# EasyEDA Pro project YanQi_Project_V2.0.eprj, board PayloadBoard
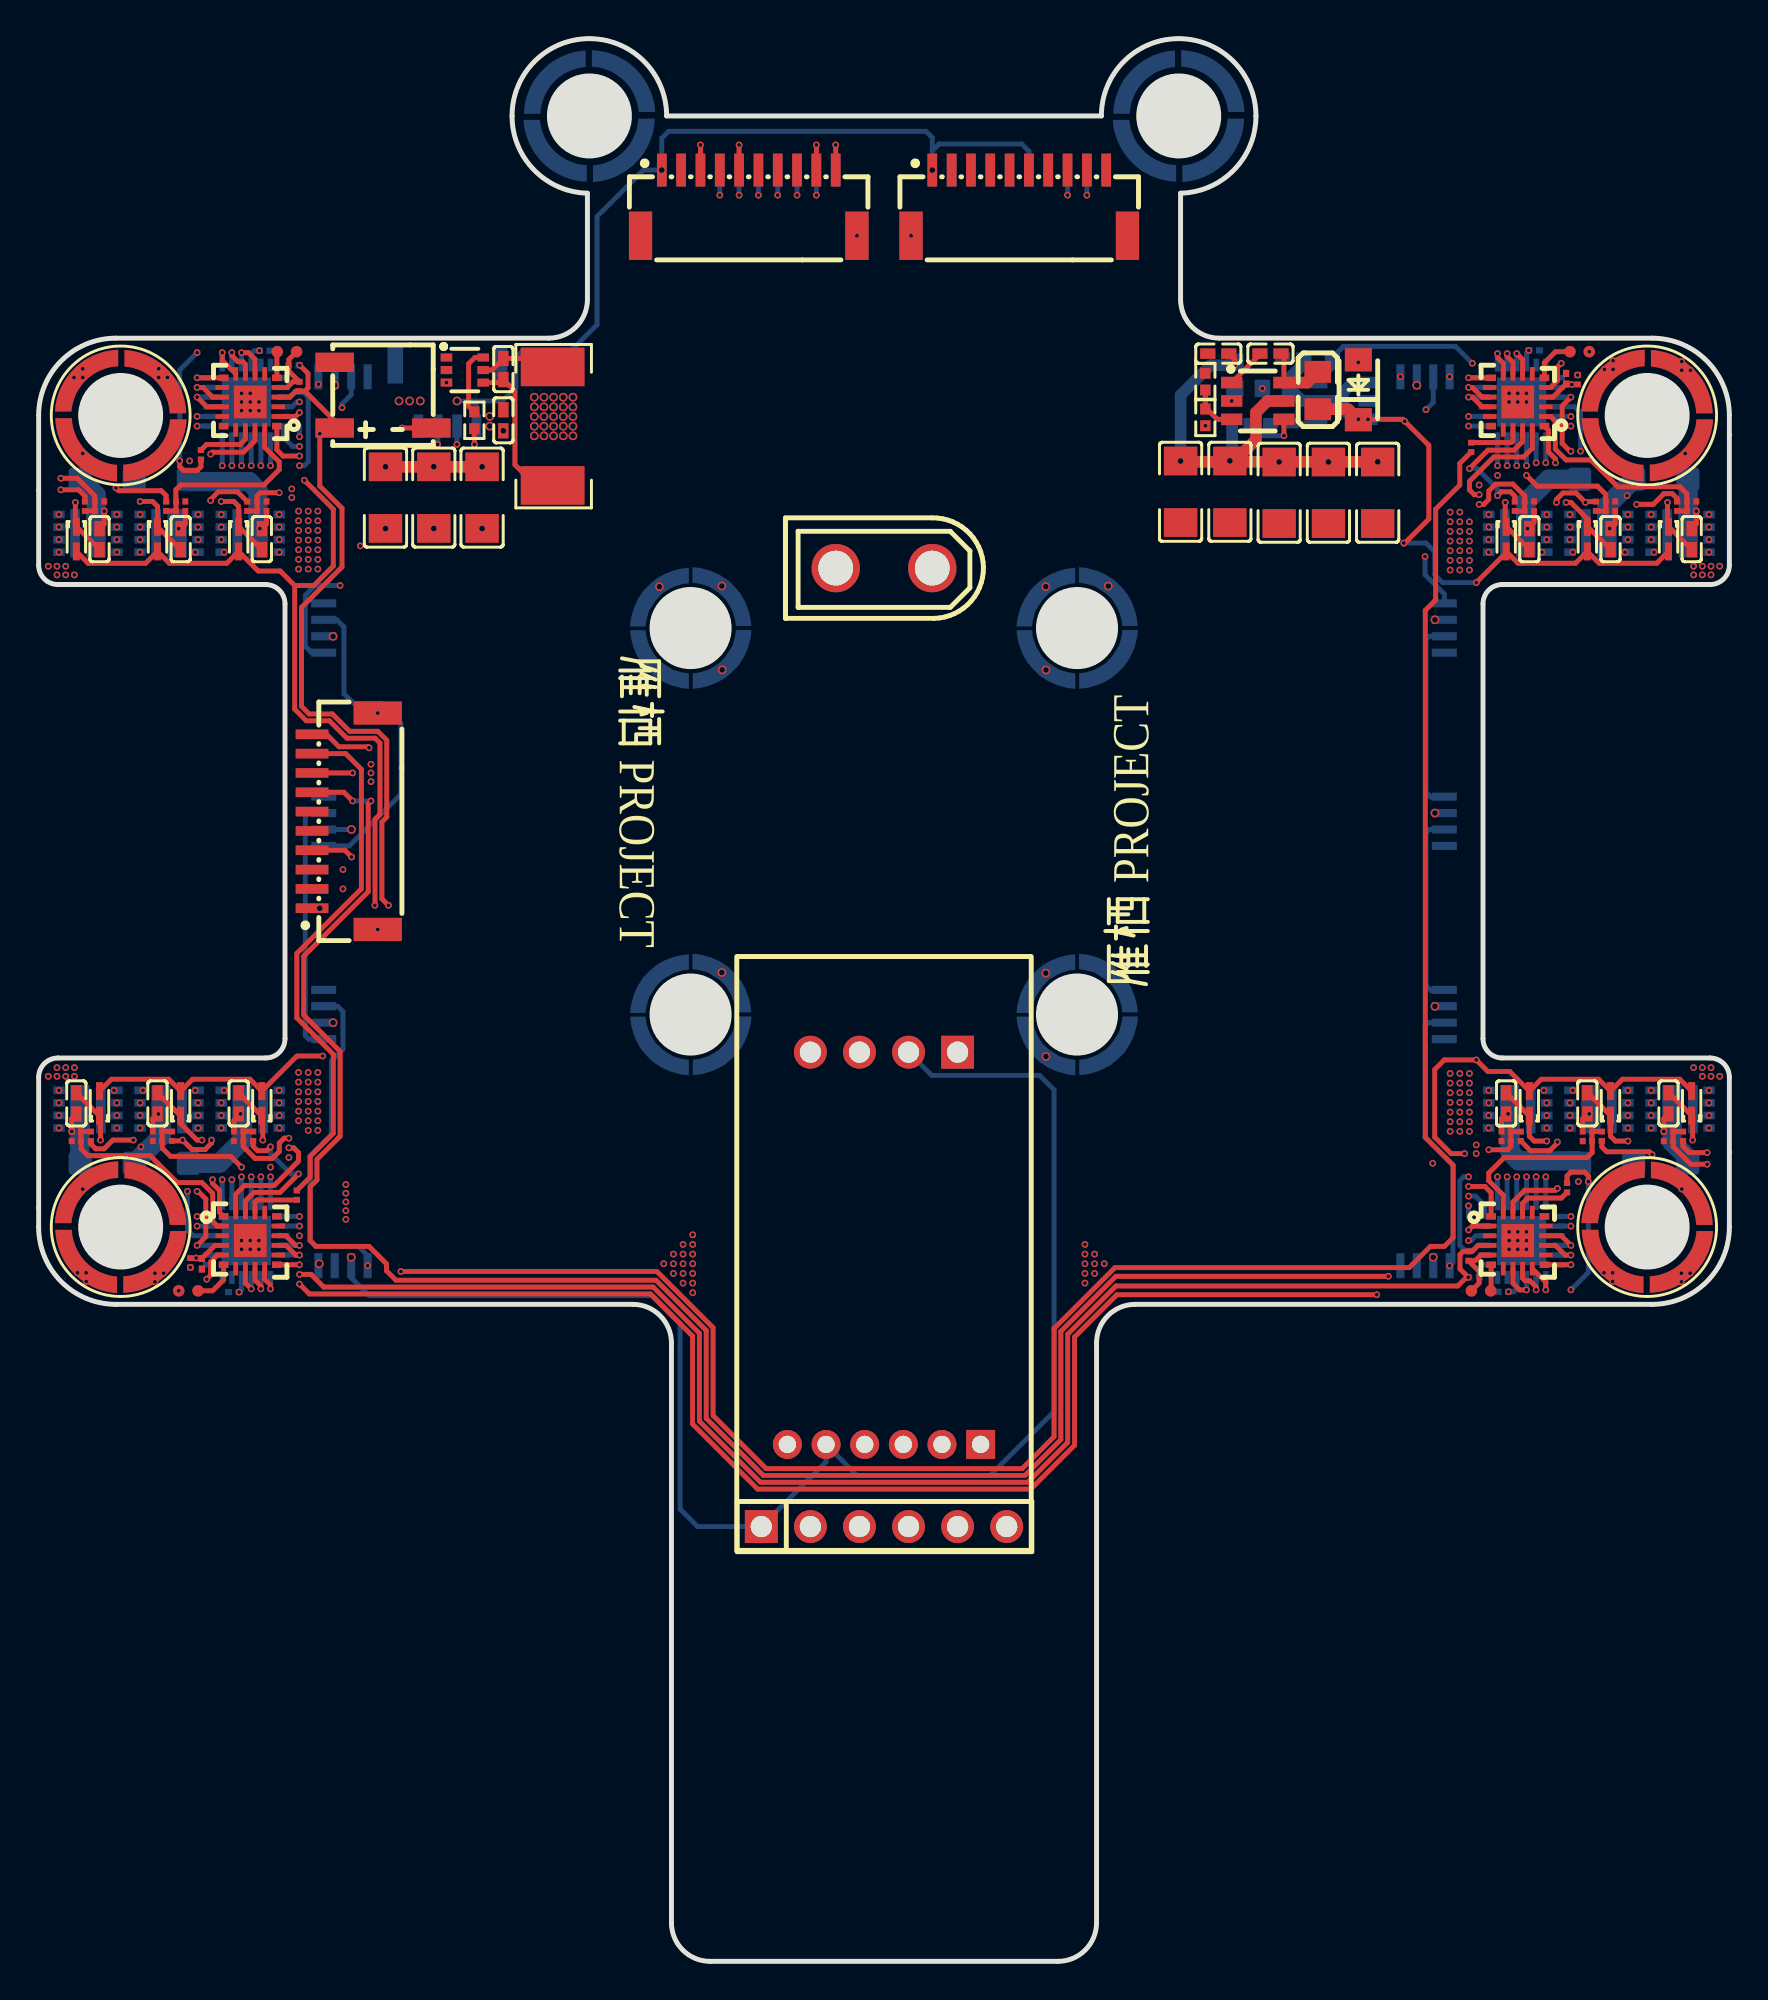
[diagram p6: board, top side]
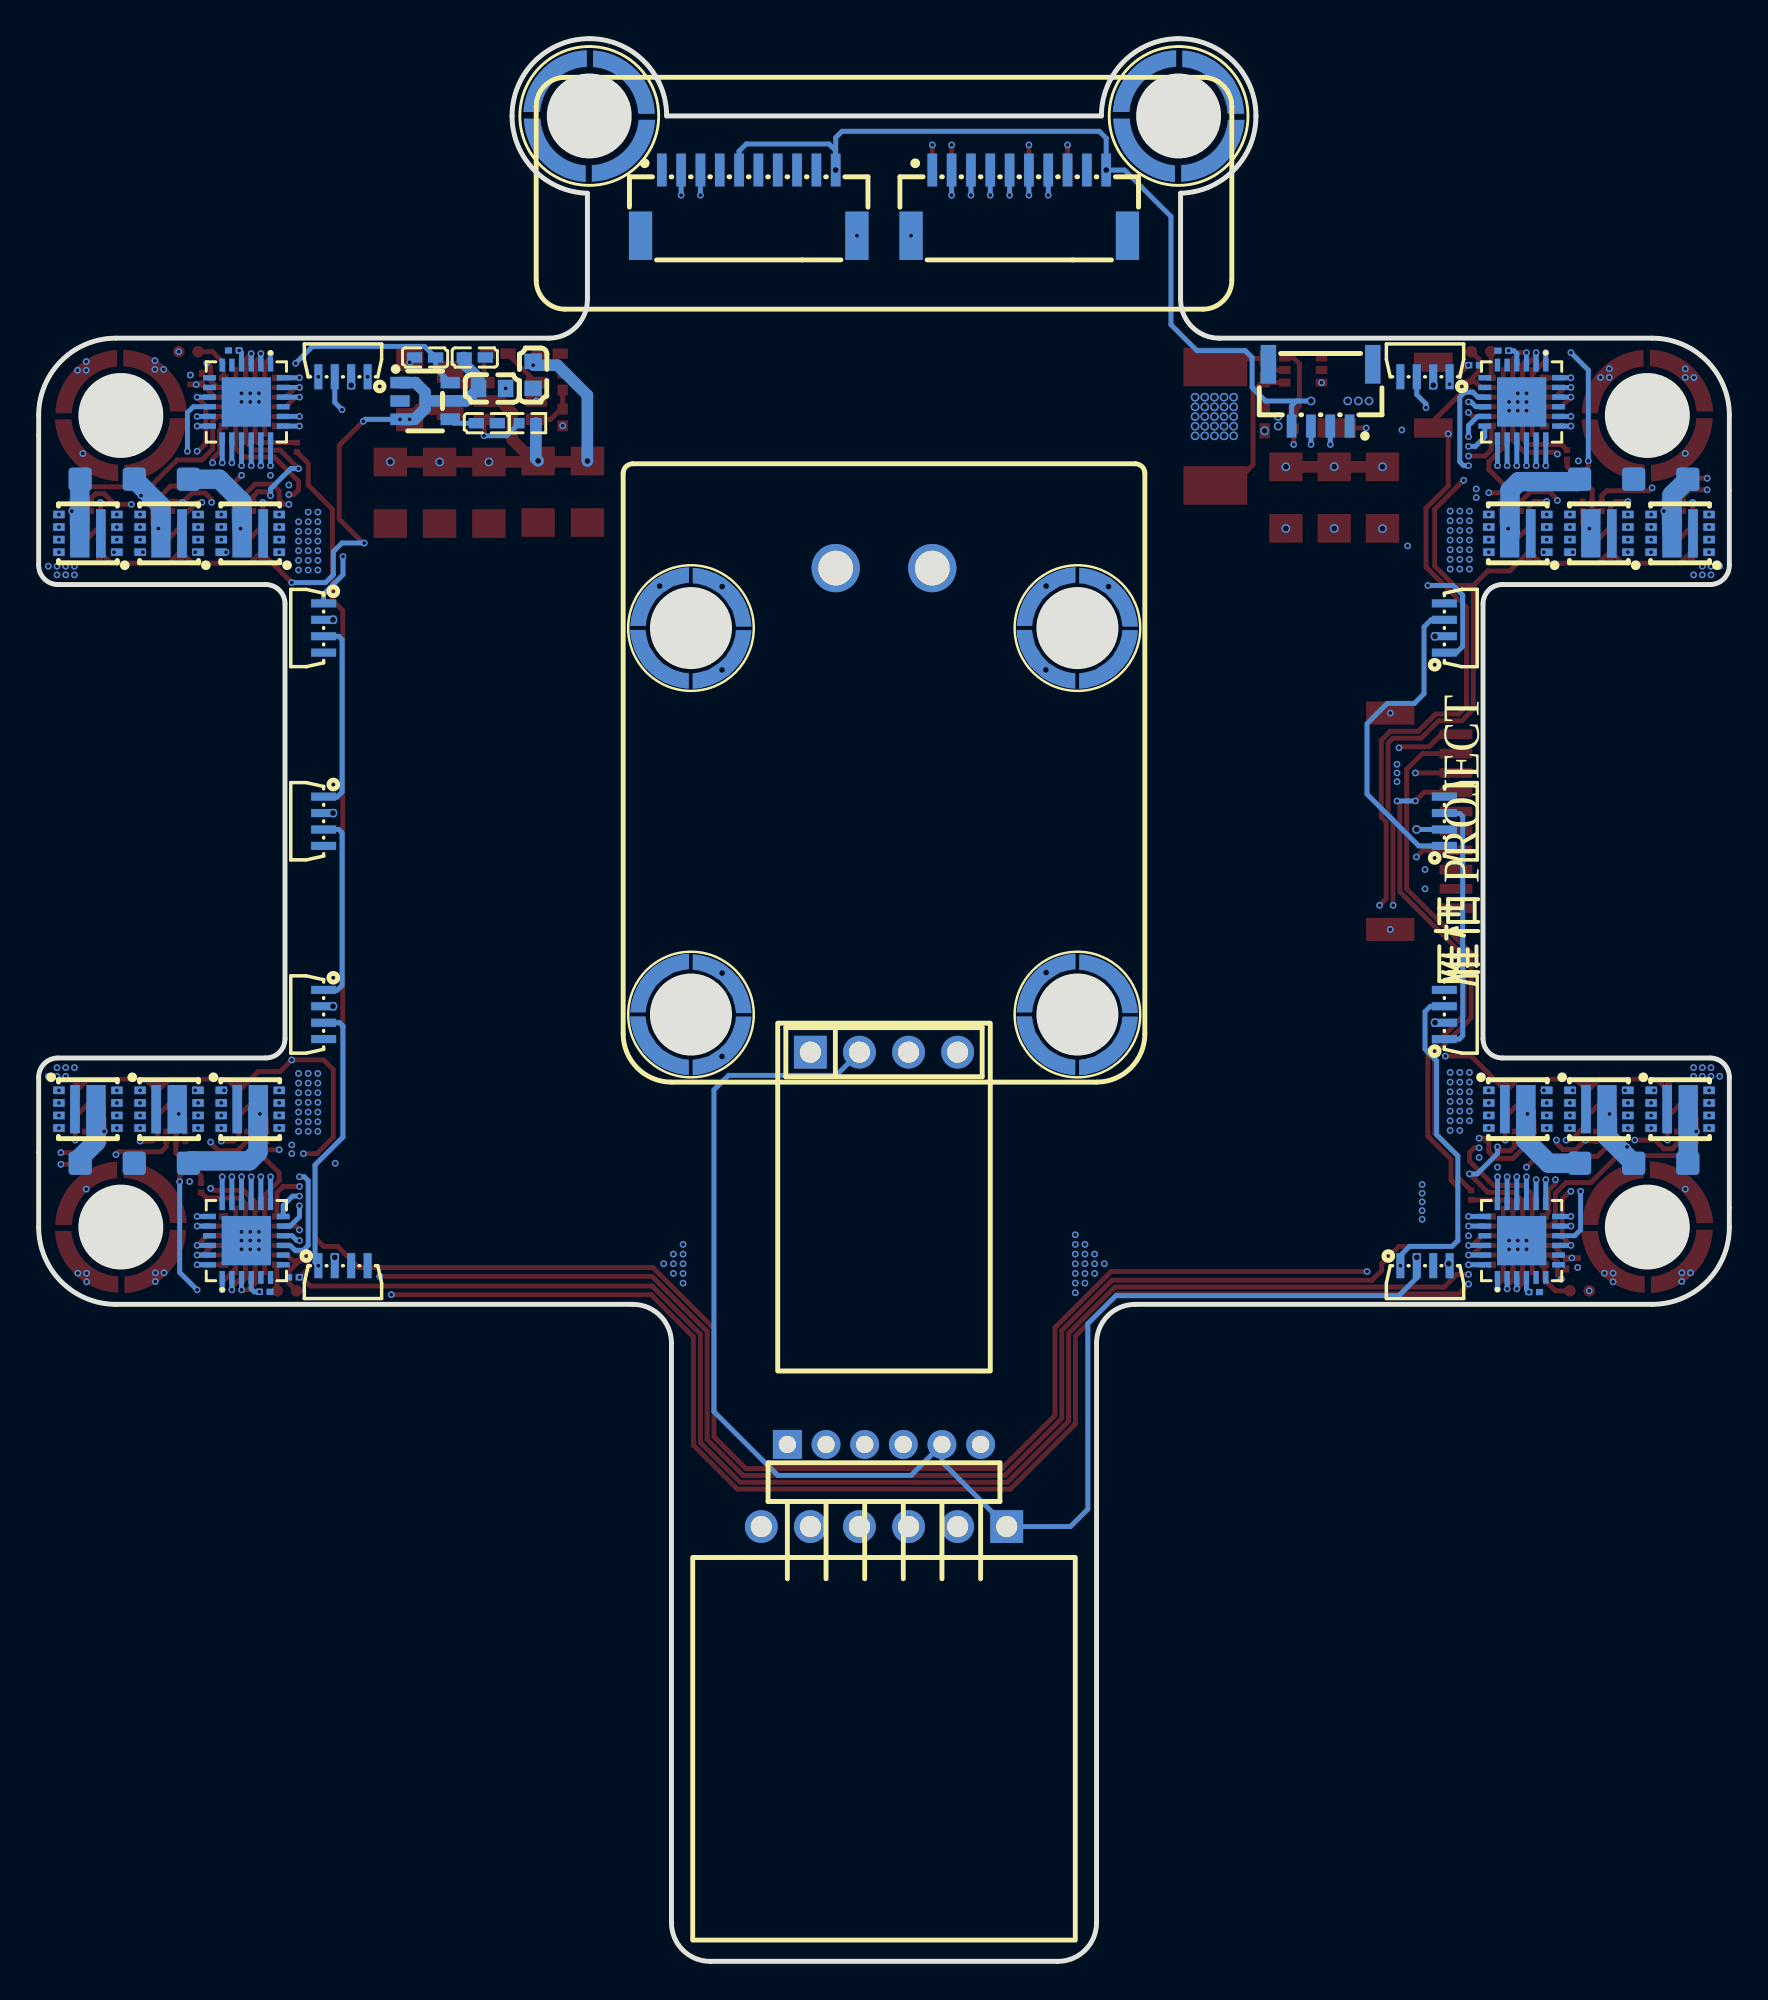
[diagram p7: board, bottom side, seen from below]

Outline 87.5 x 99.5 mm; copper layers: Top Layer, Inner1, Inner2, Bottom Layer. Coordinates in mm from the lower left corner of the outline.
Outline path: 0,80 0,72.25 arc(0.29,71.54) 1,71.25 11.75,71.25 arc(12.46,70.96) 12.75,70.25 12.75,47.75 arc(12.46,47.04) 11.75,46.75 1,46.75 arc(0.29,46.46) 0,45.75 0,38 arc(1.17,35.17) 4,34 30.75,34 arc(32.16,33.41) 32.75,32 32.75,2 arc(33.34,0.59) 34.75,0 52.75,0 arc(54.16,0.59) 54.75,2 54.75,32 arc(55.34,33.41) 56.75,34 83.5,34 arc(86.33,35.17) 87.5,38 87.5,45.75 arc(87.21,46.46) 86.5,46.75 75.75,46.75 arc(75.04,47.04) 74.75,47.75 74.75,70.25 arc(75.04,70.96) 75.75,71.25 86.5,71.25 arc(87.21,71.54) 87.5,72.25 87.5,80 arc(86.33,82.83) 83.5,84 61.1,84 arc(59.69,84.59) 59.1,86 59.1,91.5 arc(61.86,92.71) 63,95.5 arc(61.83,98.33) 59,99.5 arc(56.17,98.33) 55,95.5 32.5,95.5 arc(31.33,98.33) 28.5,99.5 arc(25.67,98.33) 24.5,95.5 arc(25.64,92.71) 28.4,91.5 28.4,86 arc(27.81,84.59) 26.4,84 4,84 arc(1.17,82.83) 0,80
Stack: Top Layer 0.035mm / Dielectric1 0.48mm PP er 4.5 / Inner1 0.035mm / Dielectric2 0.48mm FR4 er 4.5 / Inner2 0.035mm / Dielectric3 0.48mm PP er 4.5 / Bottom Layer 0.035mm

## Design rules (mm)
template: 自定义配置
spacing copperThickness1oz (default): track to track 0.1, other pairs 0.15 to 0.3
spacing copperThickness2oz: track to track 0.203, other pairs 0.152 to 0.3
spacing copperThicknessInner0.5oz: track to track 0.089, other pairs 0.152 to 0.3
track width copperThickness1oz (default): min 0.102, default 0.254, max 10
track width copperThickness2oz: min 0.203, default 0.254, max 10
track width copperThickness0.5oz: min 0.089, default 0.254, max 10
differential pair differentialPair (default): width min 0.127, default 0.254, max 2.54; gap min 0.152, default 0.152
via viaSize (default): diameter min 0.3, default 0.45, max 10; hole min 0.2, default 0.3, max 6.3

## Placement (name value [footprint] x y rotation side)
BUZZER1  4000Hz  [BUZ-SMD_4P-L5.0-W5.0-P4.00-BR]  17.82 81.05 270 top
C1  1uF  [C0402]  85.55 73.6 270 top
C2  1uF  [C0402]  81.35 73.6 270 top
C3  100nF  [C0201]  79.05 81.9 90 top
C4  100nF  [C0201]  77.4 83.36 180 bottom
C5  1uF  [C0402]  77.15 73.6 270 top
C6  1uF  [C0402]  1.95 44.4 90 top
C7  1uF  [C0402]  6.15 44.4 90 top
C8  100nF  [C0201]  8.45 36.1 270 top
C9  100nF  [C0201]  10.1 34.64 0 bottom
C10  1uF  [C0402]  10.35 44.4 90 top
C11  1uF  [C0402]  3.15 73.6 270 top
C12  1uF  [C0402]  7.35 73.6 270 top
C13  100nF  [C0201]  13.21 82.6 180 bottom
C14  100nF  [C0201]  11.7 83.35 180 bottom
C15  1uF  [C0402]  11.55 73.6 270 top
C16  1uF  [C0402]  84.35 44.4 90 top
C17  1uF  [C0402]  80.15 44.4 90 top
C18  100nF  [C0201]  74.29 35.4 0 bottom
C19  100nF  [C0201]  75.8 34.65 0 bottom
C20  1uF  [C0402]  75.95 44.4 90 top
C21  100nF  [C0402_NEW]  63.75 83.2 180 top
C22  100nF  [C0402_NEW]  61.05 83.2 0 top
C23  4.7uF  [C0603]  61.91 82.1 90 bottom
C24  10uF  [C0603]  64.03 81.4 0 bottom
C25  10uF  [C1206]  59.1 76.05 90 top
C26  10uF  [C1206]  61.65 76.05 90 top
C27  10uF  [C1206]  64.2 76 90 top
C28  10uF  [C1206]  66.75 76 90 top
C29  10uF  [C1206]  69.3 76 90 top
C30  10uF  [C1206]  17.95 75.75 90 top
C31  10uF  [C1206]  20.45 75.75 90 top
C32  10uF  [C1206]  22.95 75.75 90 top
C33  2.2uF  [C0402]  67.5 83 0 bottom
C34  1uF  [C0402]  64.93 83 0 bottom
C35  100nF  [C0402_NEW]  24.05 79.75 270 top
C36  1nF  [C0402]  24.05 82.4 90 top
C37  100nF  [C0402_NEW]  64.31 79.6 0 bottom
CN1  HDGC1002WV-S-4P  [CONN-SMD_4P-P1.00_HDGC_HDGC1002WV-S-4P]  21.15 81.05 0 bottom
CN2  XT30UPB-M  [CONN-TH_XT30UPB-M]  43.75 72.1 180 top
D1  1N4148WT T4  [SOD-523_L1.2-W0.8-LS1.6-RD]  84.35 73.6 270 top
D2  1N4148WT T4  [SOD-523_L1.2-W0.8-LS1.6-RD]  80.15 73.6 270 top
D3  1N4148WT T4  [SOD-523_L1.2-W0.8-LS1.6-RD]  75.95 73.6 270 top
D4  1N4148WT T4  [SOD-523_L1.2-W0.8-LS1.6-RD]  3.15 44.4 90 top
D5  1N4148WT T4  [SOD-523_L1.2-W0.8-LS1.6-RD]  7.35 44.4 90 top
D6  1N4148WT T4  [SOD-523_L1.2-W0.8-LS1.6-RD]  11.55 44.4 90 top
D7  1N4148WT T4  [SOD-523_L1.2-W0.8-LS1.6-RD]  1.95 73.6 270 top
D8  1N4148WT T4  [SOD-523_L1.2-W0.8-LS1.6-RD]  6.15 73.6 270 top
D9  1N4148WT T4  [SOD-523_L1.2-W0.8-LS1.6-RD]  10.35 73.6 270 top
D10  1N4148WT T4  [SOD-523_L1.2-W0.8-LS1.6-RD]  85.55 44.4 90 top
D11  1N4148WT T4  [SOD-523_L1.2-W0.8-LS1.6-RD]  81.35 44.4 90 top
D12  1N4148WT T4  [SOD-523_L1.2-W0.8-LS1.6-RD]  77.15 44.4 90 top
D13  -  [端口]  85.35 76.7 180 bottom
D14  -  [端口]  82.55 76.7 0 bottom
D15  -  [端口]  79.75 76.7 180 bottom
D16  -  [端口]  2.15 76.7 0 bottom
D17  -  [端口]  4.95 76.7 180 bottom
D18  -  [端口]  7.75 76.7 180 bottom
D19  -  [端口]  2.15 41.3 0 bottom
D20  -  [端口]  4.95 41.3 0 bottom
D21  -  [端口]  7.75 41.3 180 bottom
D22  -  [端口]  85.35 41.3 180 bottom
D23  -  [端口]  82.55 41.3 180 bottom
D24  -  [端口]  79.75 41.3 180 bottom
H1  PZ254V-11-04P  [HDR-TH_4P-P2.54-V-M]  43.75 47.05 180 bottom
H2  PZ200-1-06-W  [HDR-TH_6P-P2.00-H-M-W7.2-N]  43.75 26.75 180 bottom
H3  PZ254V-11-06P  [HDR-TH_6P-P2.54-V-M]  43.75 22.5 0 top
L1  6.8uH  [L0805]  66.2 81.29 270 top
LED1  WS2812B-4020  [LED-SMD_WS2812B-4020]  71.75 82 180 bottom
LED2  WS2812B-4020  [LED-SMD_WS2812B-4020]  72.75 69 90 bottom
LED3  WS2812B-4020  [LED-SMD_WS2812B-4020]  72.75 59 90 bottom
LED4  WS2812B-4020  [LED-SMD_WS2812B-4020]  72.75 49 90 bottom
LED5  WS2812B-4020  [LED-SMD_WS2812B-4020]  71.75 36 0 bottom
LED6  WS2812B-4020  [LED-SMD_WS2812B-4020]  15.75 82 180 bottom
LED7  WS2812B-4020  [LED-SMD_WS2812B-4020]  14.75 69 270 bottom
LED8  WS2812B-4020  [LED-SMD_WS2812B-4020]  14.75 59 270 bottom
LED9  WS2812B-4020  [LED-SMD_WS2812B-4020]  14.75 49 270 bottom
LED10  WS2812B-4020  [LED-SMD_WS2812B-4020]  15.75 36 0 bottom
Q1  AON7934  [DFN-8_L3.0-W3.0-P0.65-BL_AON7934]  84.95 73.9 90 bottom
Q2  AON7934  [DFN-8_L3.0-W3.0-P0.65-BL_AON7934]  80.75 73.9 90 bottom
Q3  AON7934  [DFN-8_L3.0-W3.0-P0.65-BL_AON7934]  76.55 73.9 90 bottom
Q4  AON7934  [DFN-8_L3.0-W3.0-P0.65-BL_AON7934]  2.55 73.9 90 bottom
Q5  AON7934  [DFN-8_L3.0-W3.0-P0.65-BL_AON7934]  6.75 73.9 90 bottom
Q6  AON7934  [DFN-8_L3.0-W3.0-P0.65-BL_AON7934]  10.95 73.9 90 bottom
Q7  AON7934  [DFN-8_L3.0-W3.0-P0.65-BL_AON7934]  2.55 44.1 270 bottom
Q8  AON7934  [DFN-8_L3.0-W3.0-P0.65-BL_AON7934]  6.75 44.1 270 bottom
Q9  AON7934  [DFN-8_L3.0-W3.0-P0.65-BL_AON7934]  10.95 44.1 270 bottom
Q10  AON7934  [DFN-8_L3.0-W3.0-P0.65-BL_AON7934]  84.95 44.1 270 bottom
Q11  AON7934  [DFN-8_L3.0-W3.0-P0.65-BL_AON7934]  80.75 44.1 270 bottom
Q12  AON7934  [DFN-8_L3.0-W3.0-P0.65-BL_AON7934]  76.55 44.1 270 bottom
R1  10kΩ  [R0201]  74.14 78.35 270 top
R2  47kΩ  [R0201]  85.55 75.05 0 top
R3  47kΩ  [R0201]  81.35 75.05 0 top
R4  47kΩ  [R0201]  77.15 75.05 0 top
R5  10kΩ  [R0201]  84.8 75.3 270 top
R6  10kΩ  [R0201]  80.6 75.3 270 top
R7  1kΩ  [R0201]  79.65 81.85 90 top
R8  10kΩ  [R0201]  76.4 75.3 270 top
R9  4.7kΩ  [R0201]  85.55 75.55 180 top
R10  4.7kΩ  [R0201]  81.35 75.55 180 top
R11  4.7kΩ  [R0201]  77.15 75.55 180 top
R12  10kΩ  [R0201]  13.36 39.65 90 top
R13  47kΩ  [R0201]  1.95 42.95 180 top
R14  47kΩ  [R0201]  6.15 42.95 180 top
R15  47kΩ  [R0201]  10.35 42.95 180 top
R16  10kΩ  [R0201]  2.7 42.7 90 top
R17  10kΩ  [R0201]  6.9 42.7 90 top
R18  1kΩ  [R0201]  7.85 36.15 270 top
R19  10kΩ  [R0201]  11.1 42.7 90 top
R20  4.7kΩ  [R0201]  1.95 42.45 0 top
R21  4.7kΩ  [R0201]  6.15 42.45 0 top
R22  4.7kΩ  [R0201]  10.35 42.45 0 top
R23  10kΩ  [R0201]  8.4 77.97 270 top
R24  47kΩ  [R0201]  3.15 75.05 0 top
R25  47kΩ  [R0201]  7.35 75.05 0 top
R26  47kΩ  [R0201]  11.55 75.05 0 top
R27  10kΩ  [R0201]  2.4 75.3 270 top
R28  10kΩ  [R0201]  6.6 75.3 270 top
R29  1kΩ  [R0201]  13.5 81.5 90 top
R30  10kΩ  [R0201]  10.8 75.3 270 top
R31  4.7kΩ  [R0201]  3.15 75.55 180 top
R32  4.7kΩ  [R0201]  7.35 75.55 180 top
R33  4.7kΩ  [R0201]  11.55 75.55 180 top
R34  10kΩ  [R0201]  79.1 40.04 90 top
R35  47kΩ  [R0201]  84.35 42.95 180 top
R36  47kΩ  [R0201]  80.15 42.95 180 top
R37  47kΩ  [R0201]  75.95 42.95 180 top
R38  10kΩ  [R0201]  85.1 42.7 90 top
R39  10kΩ  [R0201]  80.9 42.7 90 top
R40  1kΩ  [R0201]  74 36.5 270 top
R41  10kΩ  [R0201]  76.7 42.7 90 top
R42  4.7kΩ  [R0201]  84.35 42.45 0 top
R43  4.7kΩ  [R0201]  80.15 42.45 0 top
R44  4.7kΩ  [R0201]  75.95 42.45 0 top
R45  100kΩ  [R0402]  62.2 79.6 180 bottom
R46  10K  [R0402]  60.38 81.75 270 top
R47  90.9kΩ  [R0402]  60.38 79.9 270 top
R48  56Ω  [R0402]  22.55 79.75 270 top
R49  10mΩ  [RES-SMD_L6.4-W3.2-R2512]  26.6 79.44 270 top
U1  EFM8BB21F16G-C-QFN20R  [QFN-20_L3.0-W3.0-P0.50-BL-EP1.7_EFM8BB21F16G]  76.55 80.7 90 top
U2  FD6288Q  [QFN-24_L4.0-W4.0-P0.50-BL-EP2.6]  76.75 80.7 0 bottom
U3  EFM8BB21F16G-C-QFN20R  [QFN-20_L3.0-W3.0-P0.50-BL-EP1.7_EFM8BB21F16G]  10.95 37.3 270 top
U4  FD6288Q  [QFN-24_L4.0-W4.0-P0.50-BL-EP2.6]  10.75 37.3 180 bottom
U5  EFM8BB21F16G-C-QFN20R  [QFN-20_L3.0-W3.0-P0.50-BL-EP1.7_EFM8BB21F16G]  10.95 80.7 90 top
U6  FD6288Q  [QFN-24_L4.0-W4.0-P0.50-BL-EP2.6]  10.75 80.7 0 bottom
U7  EFM8BB21F16G-C-QFN20R  [QFN-20_L3.0-W3.0-P0.50-BL-EP1.7_EFM8BB21F16G]  76.55 37.3 270 top
U8  FD6288Q  [QFN-24_L4.0-W4.0-P0.50-BL-EP2.6]  76.75 37.3 180 bottom
U9  JW5026  [SOT-23-6_L2.9-W1.6-P0.95-LS2.8-BR]  63.09 80.75 180 top
U10  -  [烧录点]  80.25 83.3 0 top
U11  -  [烧录点]  7.25 34.7 180 top
U12  -  [烧录点]  13.35 83.3 0 top
U13  -  [烧录点]  74.15 34.7 0 top
U14  SMF8.0A  [SOD-123FL_L2.8-W1.8-LS3.6-RD]  68.3 81.33 90 top
U15  -  [烧录点]  79.25 83.3 0 top
U16  -  [烧录点]  8.25 34.7 180 top
U17  -  [烧录点]  12.35 83.3 0 top
U18  -  [烧录点]  75.15 34.7 0 top
U19  INA199A1DCKR  [SC-70-6_L2.2-W1.3-P0.65-LS2.1-BR]  22.06 82.35 180 top
U20  AP2210K-3.3TRG1  [SOT-23-5_L3.0-W1.7-P0.95-LS2.8-BR]  67.5 80.75 0 bottom
U21  SMTSO3050CTJ  [SMD_SMTSO3060CTJ]  4.25 80 0 top
U22  SMTSO3050CTJ  [SMD_SMTSO3060CTJ]  83.25 80 0 top
U23  SMTSO3050CTJ  [SMD_SMTSO3060CTJ]  4.25 38 0 top
U24  SMTSO3050CTJ  [SMD_SMTSO3060CTJ]  83.25 38 0 top
U25  WAFER-SH1.0-10PWB  [CONN-SMD_10P-P1.00_WAFER-SH1.0-10PWB]  36.75 91 0 top
U26  WAFER-SH1.0-10PWB  [CONN-SMD_10P-P1.00_WAFER-SH1.0-10PWB]  50.75 91 0 top
U27  WAFER-SH1.0-10PWB  [CONN-SMD_10P-P1.00_WAFER-SH1.0-10PWB]  15.85 59 90 top
U28  SMTSO3015CTJ  [SMD_BD5.6-L5.6-W5.6-D4.1]  53.75 49 180 bottom
U29  SMTSO3015CTJ  [SMD_BD5.6-L5.6-W5.6-D4.1]  33.75 49 180 bottom
U30  SMTSO3015CTJ  [SMD_BD5.6-L5.6-W5.6-D4.1]  53.75 69 180 bottom
U31  SMTSO3015CTJ  [SMD_BD5.6-L5.6-W5.6-D4.1]  33.75 69 180 bottom
U32  SMTSO3050CTJ  [SMD_SMTSO3060CTJ]  28.5 95.5 180 bottom
U33  SMTSO3050CTJ  [SMD_SMTSO3060CTJ]  59 95.5 180 bottom
U34  WAFER-SH1.0-10PWB  [CONN-SMD_10P-P1.00_WAFER-SH1.0-10PWB]  36.75 91 180 bottom
U35  WAFER-SH1.0-10PWB  [CONN-SMD_10P-P1.00_WAFER-SH1.0-10PWB]  50.75 91 180 bottom

## Footprints (pads in the part's own frame, mm; a bottom-side part is the same pattern mirrored in y, then rotated)
BUZ-SMD_4P-L5.0-W5.0-P4.00-BR
  rect 1x2 smd: 1(1.7,-2.5) 2(1.7,2.5) 3(-1.7,-2.5)
C0201
  rect 0.368x0.324 smd: 1(-0.275,0) 2(0.275,0)
C0402
  rect 0.79x0.54 smd: 1(-0.545,0) 2(0.545,0)
C0402_NEW
  rect 0.79x0.54 smd: 1(-0.545,0) 2(0.545,0)
C0603
  rect 0.8x0.9 smd: 1(-0.7,0) 2(0.7,0)
C1206
  rect 1.485x1.728 smd: 1(-1.593,0) 2(1.593,0)
CONN-SMD_4P-P1.00_HDGC_HDGC1002WV-S-4P
  rect 0.5x1.2 smd: 1(-1.5,1.6) 2(-0.5,1.6) 3(0.5,1.6) 4(1.5,1.6)
  rect 0.8x2 smd: 5(2.7,-1.6) 6(-2.7,-1.6)
CONN-SMD_10P-P1.00_WAFER-SH1.0-10PWB
  rect 0.5x1.7 smd: 1(-4.5,1.7) 2(-3.5,1.7) 3(-2.5,1.7) 4(-1.5,1.7) 5(-0.5,1.7) 6(0.5,1.7) 7(1.5,1.7) 8(2.5,1.7) 9(3.5,1.7) 10(4.5,1.7)
  rect 1.2x2.5 smd: 11(5.6,-1.7) 12(-5.6,-1.7)
CONN-TH_XT30UPB-M
  round 2.5 hole 1.8: 1(-2.5,0) 2(2.5,0)
DFN-8_L3.0-W3.0-P0.65-BL_AON7934
  rect 0.4x0.6 smd: 1(-0.975,-1.5) 2(-0.325,-1.5) 3(0.325,-1.5) 4(0.975,-1.5) 5(0.975,1.5) 6(0.325,1.5) 7(-0.325,1.5) 8(-0.975,1.5)
  rect 2.5x0.5 smd: 9(0,-0.67)
  rect 2.5x1 smd: 10(0,0.42)
HDR-TH_4P-P2.54-V-M
  rect 1.7x1.7 hole 1.1: 1(-3.81,0)
  round 1.7 hole 1.1: 2(-1.27,0) 3(1.27,0) 4(3.81,0)
HDR-TH_6P-P2.00-H-M-W7.2-N
  rect 1.5x1.5 hole 0.9: 1(-5,0)
  round 1.5 hole 0.9: 2(-3,0) 3(-1,0) 4(1,0) 5(3,0) 6(5,0)
HDR-TH_6P-P2.54-V-M
  rect 1.7x1.7 hole 1.1: 1(-6.35,0)
  round 1.7 hole 1.1: 2(-3.81,0) 3(-1.27,0) 4(1.27,0) 5(3.81,0) 6(6.35,0)
L0805
  rect 1.133x1.377 smd: 1(-0.966,0) 2(0.966,0)
LED-SMD_WS2812B-4020
  rect 0.42x1.3 smd: 1(1.275,0) 2(0.425,0) 3(-0.425,0) 4(-1.275,0)
QFN-20_L3.0-W3.0-P0.50-BL-EP1.7_EFM8BB21F16G
  rect 0.34x0.5 smd: 1(-1.252,-1.377) 6(1.248,-1.377) 11(1.248,1.377) 16(-1.252,1.377)
  rect 0.25x0.7 smd: 2(-0.751,-1.45) 3(-0.252,-1.45) 4(0.248,-1.45) 5(0.749,-1.45) 12(0.749,1.45) 13(0.248,1.45) 14(-0.252,1.45) 15(-0.751,1.45)
  rect 0.7x0.25 smd: 7(1.452,-0.75) 8(1.452,-0.25) 9(1.452,0.25) 10(1.452,0.75) 17(-1.452,0.75) 18(-1.452,0.25) 19(-1.452,-0.25) 20(-1.452,-0.75)
  rect 1.7x1.7 smd: 21(-0.002,0)
QFN-24_L4.0-W4.0-P0.50-BL-EP2.6
  rect 0.28x0.665 smd: 1(-1.25,-1.907) 2(-0.75,-1.907) 3(-0.25,-1.907) 4(0.25,-1.907) 5(0.75,-1.907) 6(1.25,-1.907) 13(1.25,1.907) 14(0.75,1.907) 15(0.25,1.907) 16(-0.25,1.907) 17(-0.75,1.907) 18(-1.25,1.907)
  rect 0.665x0.28 smd: 7(1.907,-1.25) 8(1.907,-0.75) 9(1.907,-0.25) 10(1.907,0.25) 11(1.907,0.75) 12(1.907,1.25) 19(-1.907,1.25) 20(-1.907,0.75) 21(-1.907,0.25) 22(-1.907,-0.25) 23(-1.907,-0.75) 24(-1.907,-1.25)
  rect 2.55x2.55 smd: 25(0,0)
R0201
  rect 0.303x0.324 smd: 1(-0.241,0) 2(0.241,0)
R0402
  rect 0.566x0.54 smd: 1(-0.433,0) 2(0.433,0)
RES-SMD_L6.4-W3.2-R2512
  rect 2x3.3 smd: 1(-3.067,0) 2(3.067,0)
SC-70-6_L2.2-W1.3-P0.65-LS2.1-BR
  rect 0.6x0.42 smd: 1(0.95,-0.65) 2(0.95,0) 3(0.95,0.65) 4(-0.95,0.65) 5(-0.95,0) 6(-0.95,-0.65)
SMD_BD5.6-L5.6-W5.6-D4.1
  custom 3.04x3.04 smd: 1(-1.623,-2.167) 1(-1.609,2.171) 1(1.617,-2.171) 1(1.623,2.141)
SMD_SMTSO3060CTJ
  custom 3.197x3.279 smd: 1(-1.79,-2.369)
  custom 3.279x3.197 smd: 1(-1.769,2.386) 1(1.768,-2.386)
  custom 3.197x3.278 smd: 1(1.79,2.34)
SOD-123FL_L2.8-W1.8-LS3.6-RD
  rect 1.2x1.4 smd: 1(-1.55,0) 2(1.55,0)
SOD-523_L1.2-W0.8-LS1.6-RD
  rect 0.93x0.36 smd: 1(-0.635,0) 2(0.635,0)
SOT-23-5_L3.0-W1.7-P0.95-LS2.8-BR
  rect 1x0.6 smd: 1(1.3,-0.95) 2(1.3,0) 3(1.3,0.95) 4(-1.3,0.95) 5(-1.3,-0.95)
SOT-23-6_L2.9-W1.6-P0.95-LS2.8-BR
  rect 1.1x0.6 smd: 1(1.35,-0.95) 2(1.35,0) 3(1.35,0.95) 4(-1.35,0.95) 5(-1.35,0) 6(-1.35,-0.95)
烧录点
  round 0.6 smd: 1(0,0)
端口
  rrect 1.2x1.2 smd: 1(0,0)

## Nets
As in the schematic.

Pads without a net: BUZZER1 3; H3 5; LED5 3; LED10 3; U1 7 15 16 17; U2 5 7 8 21; U3 7 15 16 17; U4 5 7 8 21; U5 7 15 16 17; U6 5 7 8 21; U7 7 15 16 17; U8 5 7 8 21

## Via types
v1: diameter 0.35, hole 0.2, Top Layer to Bottom Layer, 521 vias
v2: diameter 0.45, hole 0.3, Top Layer to Bottom Layer, 66 vias

## Routing (per net, layer and track width the routed paths; a pad name or vN(x,y) marks a point on that pad's centre or on a via; arc(x,y) is an arc through that point)
3.3V: length 229.4
  Top Layer w0.254: U3.4 9.13,37.05 8.45,36.38 7.87,36.38 R18.1 ; v1(14.55,79.05) 14.55,76.35 15.7,75.2 15.7,72.16 13.6,70.07 13.6,64.95 14,64.55 15.2,64.55 16.1,63.65 17.55,63.65 18.02,63.19 18.02,59.22 17.76,58.96 17.76,54.99 v1(18.1,54.65) ; 73.94,35.45 v1(73.99,35.4) ; 73.94,35.45 73.44,34.95 55.75,34.95 53.26,32.46 53.26,26.86 51.19,24.79 37.36,24.79 34.2,27.95 34.2,32.5 31.81,34.89 14.76,34.89 14.1,35.55 v1(13.5,35.55) ; 73.94,35.45 73.56,35.83 73.56,36.58 73.72,36.74 R40.1 74.19,36.74 74.5,37.05 U7.4 ; v1(79.35,81.6) 79.32,81.63 C3.1 78.37,80.95 U1.4 ; 13.78,81.26 15.32,79.72 BUZZER1.1 ; 13.78,81.26 13.94,81.42 13.94,82.17 v1(13.51,82.6) ; 13.78,81.26 R29.1 13.31,81.26 13,80.95 U5.4
  Inner1 w0.254: v2(24.05,79.2) 24.05,80.35 21.8,82.6 21.1,82.6 ; v1(8.15,36.4) 9.7,36.4 10.35,35.75 12.38,35.75 12.58,35.55 v1(13.5,35.55) ; 21.1,82.6 v1(13.51,82.6) ; 21.1,82.6 21.11,82.6 v1(21.11,81.7) ; v1(79.35,81.6) 79.25,81.6 78.15,82.7 v1(74.2,82.7) 70.5,82.7 69.95,82.15 69.95,81.52 71.45,80.02 71.45,73.03 71.29,72.88 71.29,72.52 71.75,72.06 71.75,42.65 72.85,41.55 72.85,38.1 71.45,36.7 71.45,35.9 71.95,35.4 v1(73.99,35.4)
  Inner2 w0.254: v1(13.5,35.55) 13.9,35.55 14,35.45 14.7,35.45 15.05,35.8 15.05,36.55 14.4,37.2 14.4,41.5 15.6,42.7 15.6,47.55 16.1,48.05 16.1,49.1 15.6,49.6 15.6,52.22 18.04,54.65 v1(18.1,54.65)
  Bottom Layer w0.254: U20.5 66.96,82.45 C33.1 67.53,83.57 73.33,83.57 74.2,82.7
5V: length 261.4
  Inner1 w0.254: v2(72.18,36.44) 72.69,36.44 73.2,36.95 73.2,41.75 72.26,42.69 v2(72.26,49.42) v2(72.26,59.42) v2(72.26,69.42) 72.26,80.62 v2(71.32,81.56) ; v2(21.65,80.75) 20.9,80.75 20.09,81.56 v2(15.33,81.56) 15,81.24 15,68.8 v2(15.24,68.57) 15.24,59.52 v2(16.19,58.58) 15.24,57.62 v2(15.24,48.58) 15.24,42.84 14.05,41.65 14.05,38 15.4,36.65 15.96,36.65 v2(16.17,36.44)
  Inner2 w0.254: v2(71.32,81.56) 71.16,81.4 70.3,81.4 68.48,83.22 59.83,83.22 58.25,84.8 58.25,91.9 55.5,94.65 46.55,94.65 46.25,94.35 v2(46.25,92.7)
  Bottom Layer w0.254: 22.4,80.75 24,80.75 24.7,81.45 24.7,83 25.05,83.35 27.55,83.35 28.9,84.7 28.9,90.3 31.3,92.7 v2(32.25,92.7) 32.25,94.35 32.6,94.7 45.92,94.7 46.25,94.38 46.25,93.7 ; 22.4,80.75 22.65,80.5 CN1.4 ; 22.4,80.75 v2(21.65,80.75) ; LED10.2 16.17,35.38 17.1,34.45 31.75,34.45 33.2,33 33.2,23.4 34.1,22.5 H3.1 40.75,25.85 H2.5 42.35,25.15 49.25,25.15 52.55,28.45 52.55,45.1 51.8,45.85 46.22,45.85 H1.2 ; LED8.2 v2(16.19,58.58) ; 46.25,93.7 46.6,94.05 50.88,94.05 51.25,93.68 U35.5 ; 46.25,93.7 v2(46.25,92.7)
8V: length 295.9
  Top Layer w0.254: D10.2 84.94,45.65 81.97,45.65 D11.2 80.74,45.65 77.76,45.65 D12.2 76.13,46.05 75,46.05 v1(74.4,46.65) 72.75,46.65 72.25,46.15 72.25,42.65 73.1,41.8 v1(73.8,41.8) ; D4.2 3.77,45.65 6.74,45.65 D5.2 7.97,45.65 10.94,45.65 D6.2 13.37,46.85 v1(14.7,46.85) ; v1(68.8,79.8) 70.6,79.8 v1(70.7,79.7) 71.95,78.45 71.95,74.64 70.65,73.34 v1(70.65,73.4) ; v1(13.75,76.65) 15.25,75.15 15.25,72.21 14.24,71.2 13.25,71.2 ; v1(17.4,54.65) 17.41,54.66 17.41,59.11 17.66,59.36 17.66,63.05 17.41,63.3 15.95,63.3 15.05,64.2 13.85,64.2 13.25,64.8 13.25,71.2 ; D9.2 11.36,71.95 12.5,71.95 13.25,71.2 ; v1(69.25,34.5) 55.8,34.5 53.61,32.31 53.61,26.71 51.34,24.44 37.21,24.44 33.84,27.81 33.84,32.36 31.66,34.54 14.01,34.54 v1(13.5,35.05) ; 10.35,72.97 9.73,72.35 6.77,72.35 6.15,72.97 5.53,72.35 2.56,72.35 1.95,72.97 ; D1.2 83.74,72.35 80.76,72.35 D2.2 79.53,72.35 76.56,72.35 D3.2 75.95,72.9 v1(74.4,71.35)
  Top Layer w0.6: v1(68.3,79.8) 67.78,80.32 L1.2
  Inner1 w0.254: v1(70.7,79.7) 70.6,79.8 v1(68.8,79.8) v1(68.3,79.8) 67.97,79.47 v1(60.38,79.47) ; v1(72.15,41.3) 72.49,40.96 72.49,38.74 69.25,35.5 v1(69.25,34.5) 75.92,34.5 v1(76.07,34.65) ; v1(10.37,34.64) 10.37,34.94 10.79,35.35 12.28,35.35 12.58,35.05 v1(13.5,35.05) 13.99,35.05 14.02,35.02 14.02,37.22 13.7,37.55 v1(13.5,37.55) ; v1(11.43,83.35) 11.43,81.62 11.9,81.15 13.69,81.15 14.05,80.79 14.05,76.95 v1(13.75,76.65)